# Altium schematic sheet GridSeed.SchDoc (part 1 of 2) (continued)
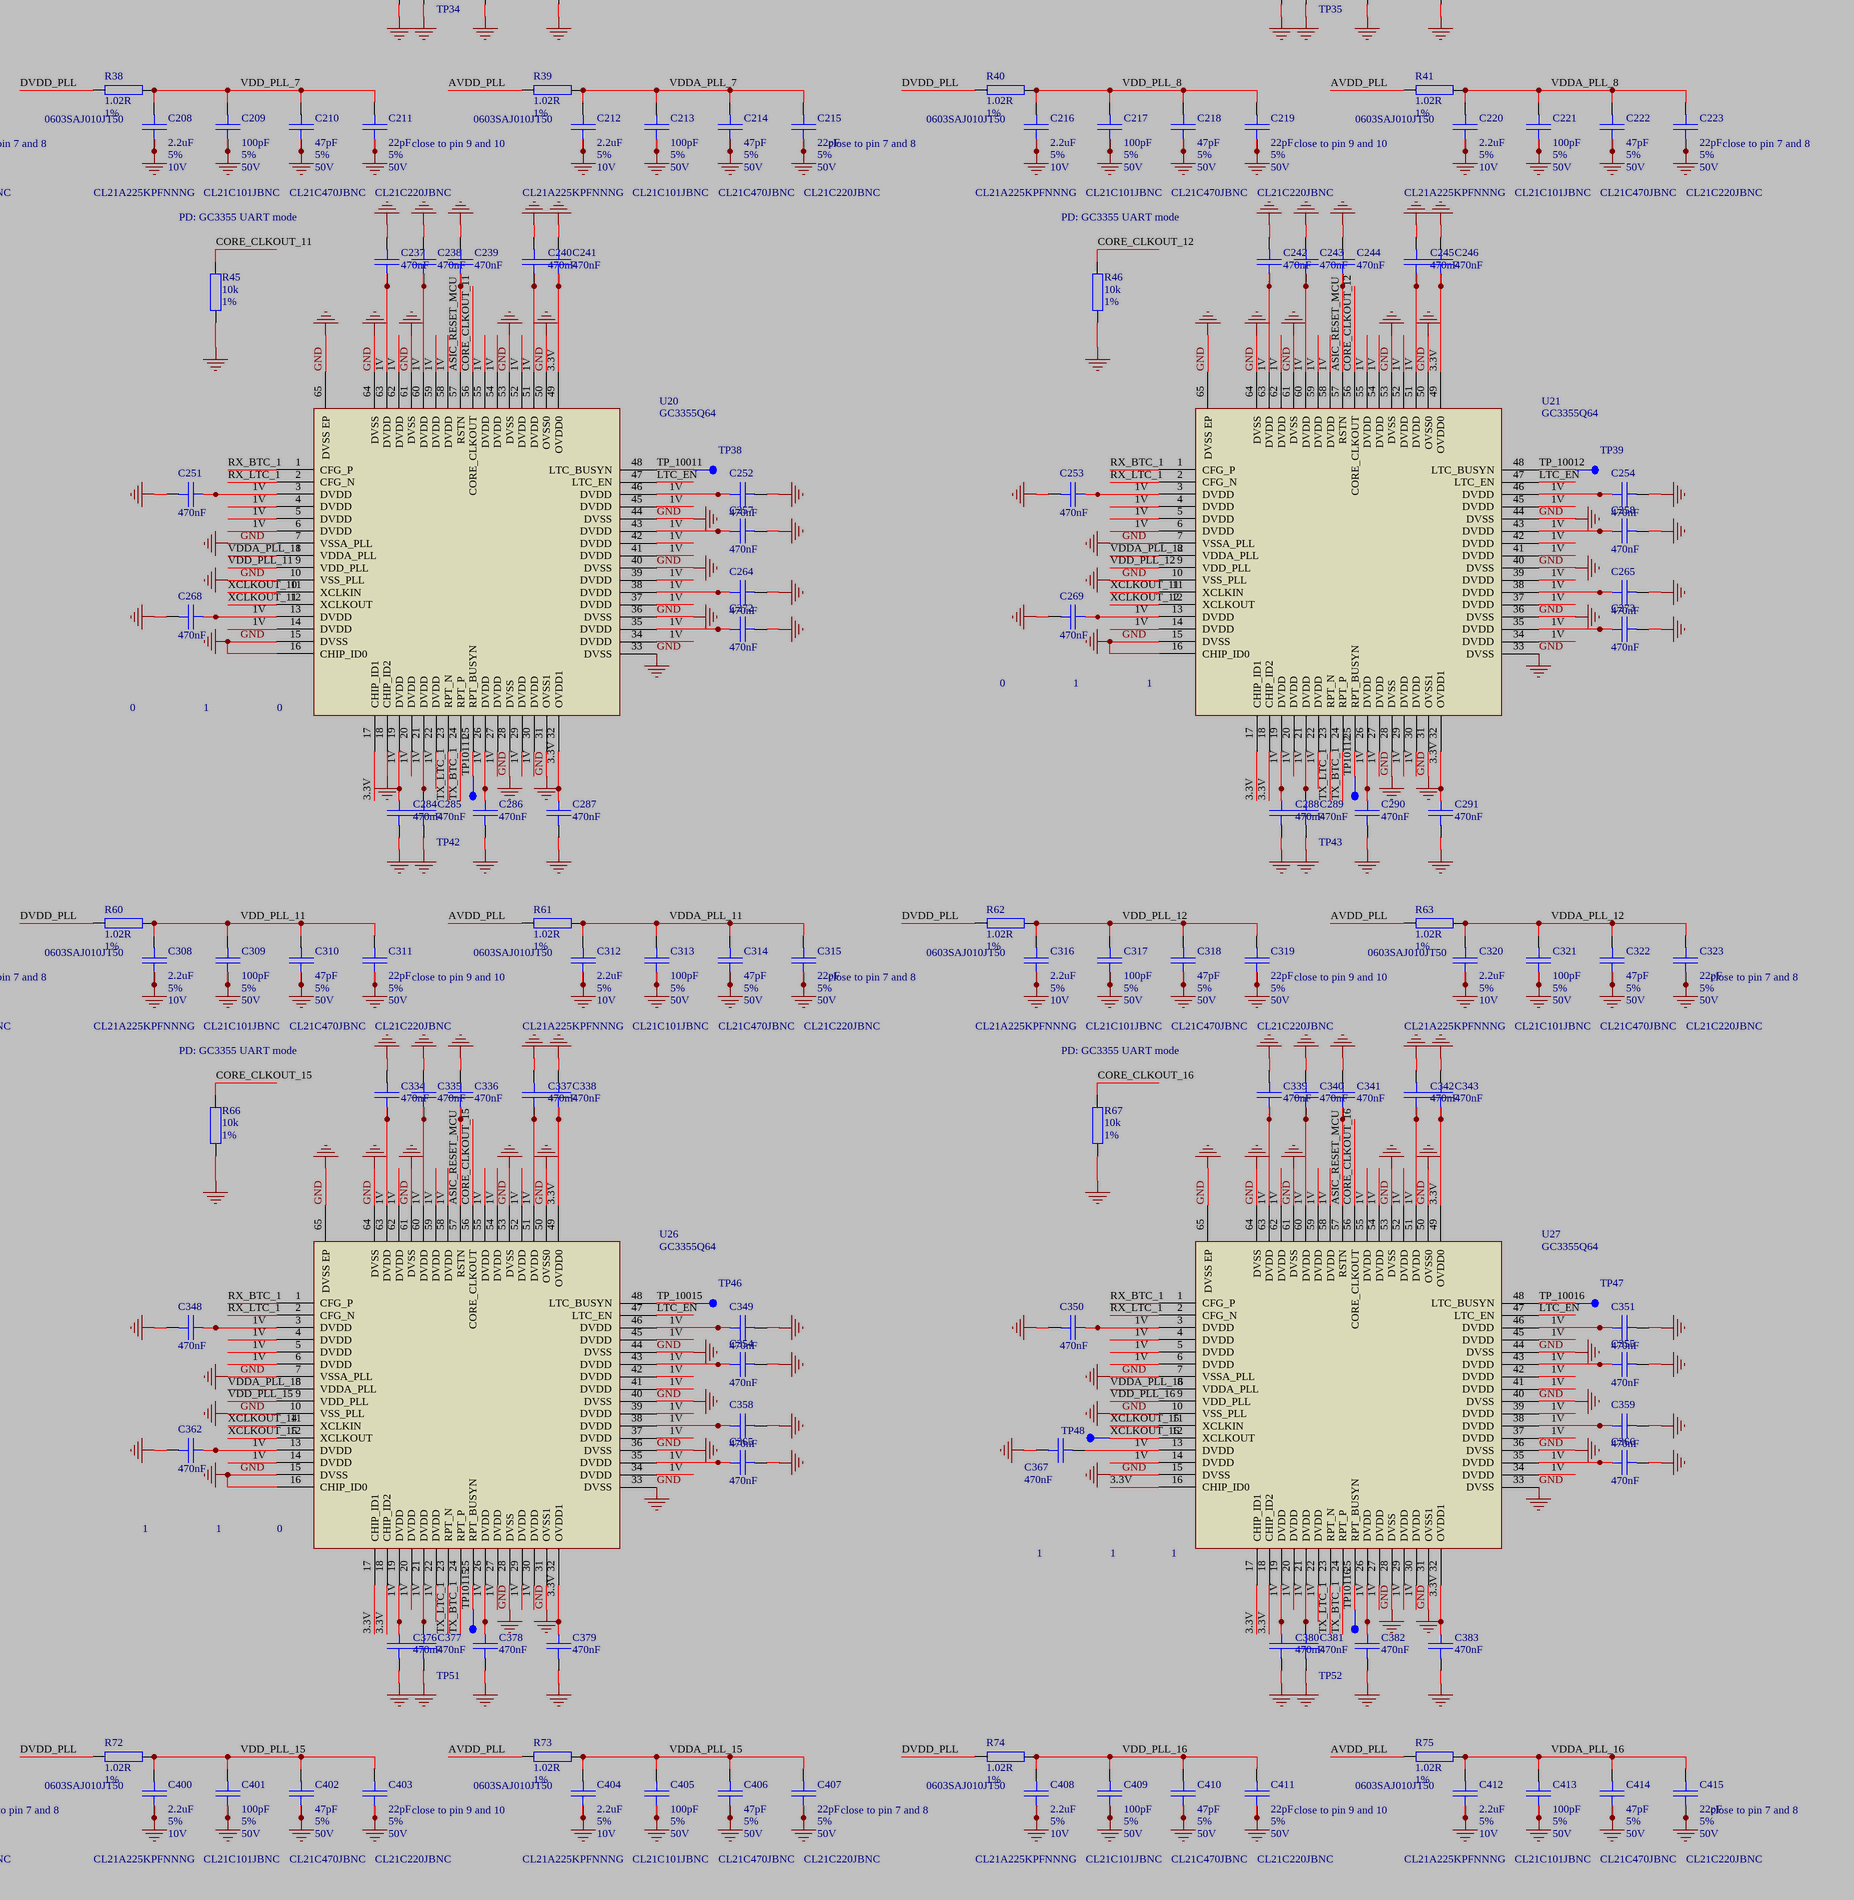
[diagram p4: GridSeed.SchDoc, bottom middle]
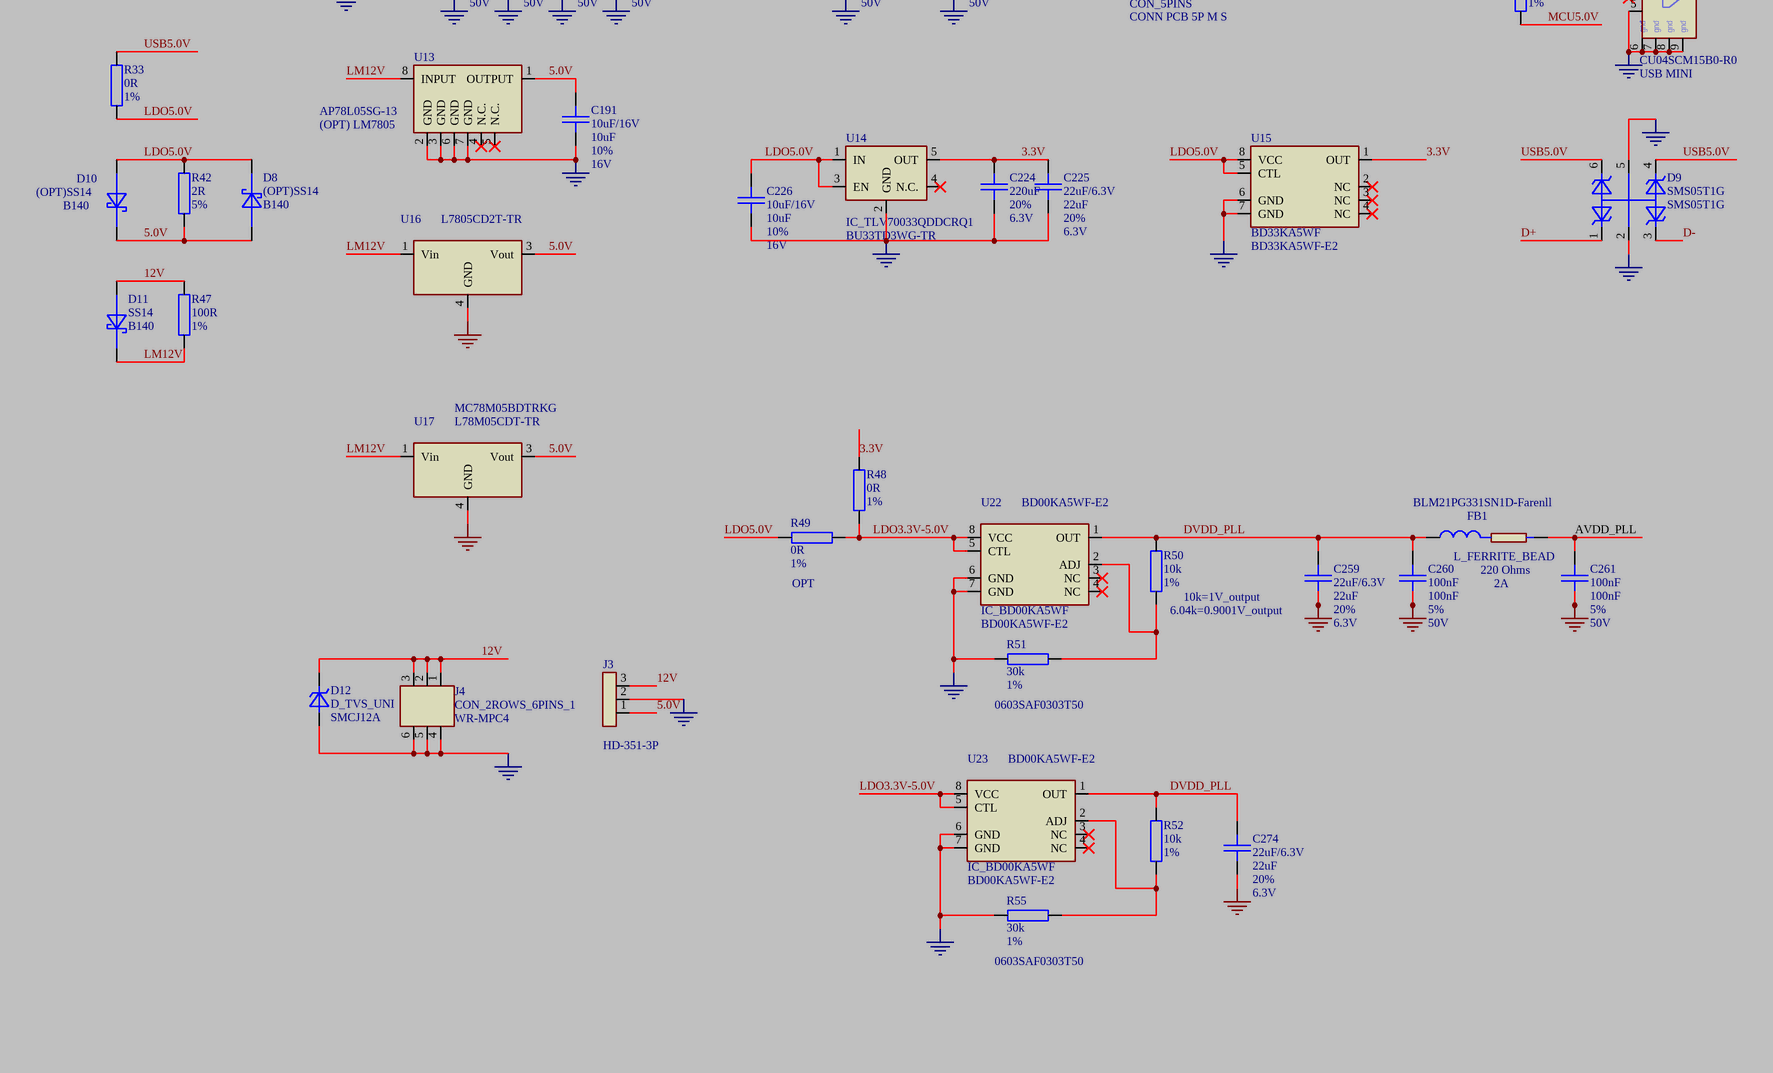
[diagram p5: GridSeed.SchDoc, bottom right]

## Parts
C1  10uF/16V  DB_VALUE: 10uF  DB_TOLERANCE: 10%  DB_VOLTAGE: 16V  [SMD_0805_CAPC2012X145N]
C2  10uF/16V  DB_VALUE: 10uF  DB_TOLERANCE: 10%  DB_VOLTAGE: 16V  [SMD_0805_CAPC2012X145N]
C3  10uF/16V  DB_VALUE: 10uF  DB_TOLERANCE: 10%  DB_VOLTAGE: 16V  [SMD_0805_CAPC2012X145N]
C4  1uF/16V  DB_VALUE: 1uF  DB_TOLERANCE: 5%  DB_VOLTAGE: 16V  [SMD_0805_CAPC2012X145N]
C5  1uF/16V  DB_VALUE: 1uF  DB_TOLERANCE: 5%  DB_VOLTAGE: 16V  [SMD_0805_CAPC2012X145N]
C6  1uF/16V  DB_VALUE: 1uF  DB_TOLERANCE: 5%  DB_VOLTAGE: 16V  [SMD_0805_CAPC2012X145N]
C7  100nF/50V  DB_VALUE: 100nF  DB_TOLERANCE: 10%  DB_VOLTAGE: 50V  [SMD_0805_CAPC2012X145N]
C8  100nF/50V  DB_VALUE: 100nF  DB_TOLERANCE: 10%  DB_VOLTAGE: 50V  [SMD_0805_CAPC2012X145N]
C9  100nF/50V  DB_VALUE: 100nF  DB_TOLERANCE: 10%  DB_VOLTAGE: 50V  [SMD_0805_CAPC2012X145N]
C10  DB_VALUE: 100uF  DB_TOLERANCE: 20%  DB_VOLTAGE: 6.3V  [SMD_1210_CAPC3225X270N]
C11  DB_VALUE: 100uF  DB_TOLERANCE: 20%  DB_VOLTAGE: 6.3V  [SMD_1210_CAPC3225X270N]
C12  DB_VALUE: 220uF  DB_TOLERANCE: 20%  DB_VOLTAGE: 6.3V  [SMD_1210_CAPC3225X270N]
C13  DB_VALUE: 220uF  DB_TOLERANCE: 20%  DB_VOLTAGE: 6.3V  [SMD_1210_CAPC3225X270N]
C14  DB_VALUE: 220uF  DB_TOLERANCE: 20%  DB_VOLTAGE: 6.3V  [SMD_1210_CAPC3225X270N]
C15  DB_VALUE: 100uF  DB_TOLERANCE: 20%  DB_VOLTAGE: 6.3V  [SMD_1210_CAPC3225X270N]
C16  DB_VALUE: 100uF  DB_TOLERANCE: 20%  DB_VOLTAGE: 6.3V  [SMD_1210_CAPC3225X270N]
C17  DB_VALUE: 220uF  DB_TOLERANCE: 20%  DB_VOLTAGE: 6.3V  [SMD_1210_CAPC3225X270N]
C18  DB_VALUE: 220uF  DB_TOLERANCE: 20%  DB_VOLTAGE: 6.3V  [SMD_1210_CAPC3225X270N]
C19  DB_VALUE: 220uF  DB_TOLERANCE: 20%  DB_VOLTAGE: 6.3V  [SMD_1210_CAPC3225X270N]
C20  DB_VALUE: 100uF  DB_TOLERANCE: 20%  DB_VOLTAGE: 6.3V  [SMD_1210_CAPC3225X270N]
C21  DB_VALUE: 100uF  DB_TOLERANCE: 20%  DB_VOLTAGE: 6.3V  [SMD_1210_CAPC3225X270N]
C22  DB_VALUE: 220uF  DB_TOLERANCE: 20%  DB_VOLTAGE: 6.3V  [SMD_1210_CAPC3225X270N]
C23  DB_VALUE: 220uF  DB_TOLERANCE: 20%  DB_VOLTAGE: 6.3V  [SMD_1210_CAPC3225X270N]
C24  DB_VALUE: 220uF  DB_TOLERANCE: 20%  DB_VOLTAGE: 6.3V  [SMD_1210_CAPC3225X270N]
C25  DB_VALUE: 470nF  [SMD_0603_CAPC1608X95N]
C26  DB_VALUE: 470nF  [SMD_0603_CAPC1608X95N]
C27  DB_VALUE: 470nF  [SMD_0603_CAPC1608X95N]
C28  DB_VALUE: 470nF  [SMD_0603_CAPC1608X95N]
C29  DB_VALUE: 470nF  [SMD_0603_CAPC1608X95N]
C30  DB_VALUE: 470nF  [SMD_0603_CAPC1608X95N]
C31  DB_VALUE: 470nF  [SMD_0603_CAPC1608X95N]
C32  DB_VALUE: 470nF  [SMD_0603_CAPC1608X95N]
C33  DB_VALUE: 470nF  [SMD_0603_CAPC1608X95N]
C34  DB_VALUE: 470nF  [SMD_0603_CAPC1608X95N]
C35  DB_VALUE: 470nF  [SMD_0603_CAPC1608X95N]
C36  DB_VALUE: 470nF  [SMD_0603_CAPC1608X95N]
C37  DB_VALUE: 470nF  [SMD_0603_CAPC1608X95N]
C38  DB_VALUE: 470nF  [SMD_0603_CAPC1608X95N]
C39  DB_VALUE: 470nF  [SMD_0603_CAPC1608X95N]
C40  DB_VALUE: 470nF  [SMD_0603_CAPC1608X95N]
C41  DB_VALUE: 470nF  [SMD_0603_CAPC1608X95N]
C42  DB_VALUE: 470nF  [SMD_0603_CAPC1608X95N]
C43  DB_VALUE: 470nF  [SMD_0603_CAPC1608X95N]
C44  DB_VALUE: 470nF  [SMD_0603_CAPC1608X95N]
C45  DB_VALUE: 470nF  [SMD_0603_CAPC1608X95N]
C46  DB_VALUE: 470nF  [SMD_0603_CAPC1608X95N]
C47  DB_VALUE: 470nF  [SMD_0603_CAPC1608X95N]
C48  DB_VALUE: 470nF  [SMD_0603_CAPC1608X95N]
C49  DB_VALUE: 470nF  [SMD_0603_CAPC1608X95N]
C50  DB_VALUE: 470nF  [SMD_0603_CAPC1608X95N]
C51  DB_VALUE: 470nF  [SMD_0603_CAPC1608X95N]
C52  DB_VALUE: 470nF  [SMD_0603_CAPC1608X95N]
C53  DB_VALUE: 470nF  [SMD_0603_CAPC1608X95N]
C54  DB_VALUE: 470nF  [SMD_0603_CAPC1608X95N]
C55  DB_VALUE: 470nF  [SMD_0603_CAPC1608X95N]
C56  DB_VALUE: 470nF  [SMD_0603_CAPC1608X95N]
C57  DB_VALUE: 470nF  [SMD_0603_CAPC1608X95N]
C58  DB_VALUE: 470nF  [SMD_0603_CAPC1608X95N]
C59  DB_VALUE: 470nF  [SMD_0603_CAPC1608X95N]
C60  DB_VALUE: 470nF  [SMD_0603_CAPC1608X95N]
C61  DB_VALUE: 470nF  [SMD_0603_CAPC1608X95N]
C62  DB_VALUE: 470nF  [SMD_0603_CAPC1608X95N]
C63  DB_VALUE: 470nF  [SMD_0603_CAPC1608X95N]
C64  DB_VALUE: 470nF  [SMD_0603_CAPC1608X95N]
C65  DB_VALUE: 470nF  [SMD_0603_CAPC1608X95N]
C66  DB_VALUE: 470nF  [SMD_0603_CAPC1608X95N]
C67  DB_VALUE: 470nF  [SMD_0603_CAPC1608X95N]
C68  DB_VALUE: 470nF  [SMD_0603_CAPC1608X95N]
C69  10uF/16V  DB_VALUE: 10uF  DB_TOLERANCE: 10%  DB_VOLTAGE: 16V  [SMD_0805_CAPC2012X145N]
C70  DB_VALUE: 470nF  [SMD_0603_CAPC1608X95N]
C71  DB_VALUE: 470nF  [SMD_0603_CAPC1608X95N]
C72  DB_VALUE: 470nF  [SMD_0603_CAPC1608X95N]
C73  DB_VALUE: 470nF  [SMD_0603_CAPC1608X95N]
C74  DB_VALUE: 470nF  [SMD_0603_CAPC1608X95N]
C75  DB_VALUE: 470nF  [SMD_0603_CAPC1608X95N]
C76  DB_VALUE: 470nF  [SMD_0603_CAPC1608X95N]
C77  DB_VALUE: 470nF  [SMD_0603_CAPC1608X95N]
C78  DB_VALUE: 470nF  [SMD_0603_CAPC1608X95N]
C79  DB_VALUE: 470nF  [SMD_0603_CAPC1608X95N]
C80  DB_VALUE: 470nF  [SMD_0603_CAPC1608X95N]
C81  DB_VALUE: 470nF  [SMD_0603_CAPC1608X95N]
C82  DB_VALUE: 470nF  [SMD_0603_CAPC1608X95N]
C83  DB_VALUE: 470nF  [SMD_0603_CAPC1608X95N]
C84  DB_VALUE: 470nF  [SMD_0603_CAPC1608X95N]
C85  DB_VALUE: 470nF  [SMD_0603_CAPC1608X95N]
C86  DB_VALUE: 2.2uF  DB_TOLERANCE: 5%  DB_VOLTAGE: 10V  [SMD_0805_CAPC2012X145N]
C87  DB_VALUE: 100pF  DB_TOLERANCE: 5%  DB_VOLTAGE: 50V  [SMD_0805_CAPC2012X145N]
C88  DB_VALUE: 47pF  DB_TOLERANCE: 5%  DB_VOLTAGE: 50V  [SMD_0805_CAPC2012X145N]
C89  DB_VALUE: 22pF  DB_TOLERANCE: 5%  DB_VOLTAGE: 50V  [SMD_0805_CAPC2012X145N]
C90  DB_VALUE: 2.2uF  DB_TOLERANCE: 5%  DB_VOLTAGE: 10V  [SMD_0805_CAPC2012X145N]
C91  DB_VALUE: 100pF  DB_TOLERANCE: 5%  DB_VOLTAGE: 50V  [SMD_0805_CAPC2012X145N]
C92  DB_VALUE: 47pF  DB_TOLERANCE: 5%  DB_VOLTAGE: 50V  [SMD_0805_CAPC2012X145N]
C93  DB_VALUE: 22pF  DB_TOLERANCE: 5%  DB_VOLTAGE: 50V  [SMD_0805_CAPC2012X145N]
C94  DB_VALUE: 2.2uF  DB_TOLERANCE: 5%  DB_VOLTAGE: 10V  [SMD_0805_CAPC2012X145N]
C95  DB_VALUE: 100pF  DB_TOLERANCE: 5%  DB_VOLTAGE: 50V  [SMD_0805_CAPC2012X145N]
C96  DB_VALUE: 47pF  DB_TOLERANCE: 5%  DB_VOLTAGE: 50V  [SMD_0805_CAPC2012X145N]
C97  DB_VALUE: 22pF  DB_TOLERANCE: 5%  DB_VOLTAGE: 50V  [SMD_0805_CAPC2012X145N]
C98  DB_VALUE: 2.2uF  DB_TOLERANCE: 5%  DB_VOLTAGE: 10V  [SMD_0805_CAPC2012X145N]
C99  DB_VALUE: 100pF  DB_TOLERANCE: 5%  DB_VOLTAGE: 50V  [SMD_0805_CAPC2012X145N]
C100  DB_VALUE: 47pF  DB_TOLERANCE: 5%  DB_VOLTAGE: 50V  [SMD_0805_CAPC2012X145N]
C101  DB_VALUE: 22pF  DB_TOLERANCE: 5%  DB_VOLTAGE: 50V  [SMD_0805_CAPC2012X145N]
C102  DB_VALUE: 2.2uF  DB_TOLERANCE: 5%  DB_VOLTAGE: 10V  [SMD_0805_CAPC2012X145N]
C103  DB_VALUE: 100pF  DB_TOLERANCE: 5%  DB_VOLTAGE: 50V  [SMD_0805_CAPC2012X145N]
C104  DB_VALUE: 47pF  DB_TOLERANCE: 5%  DB_VOLTAGE: 50V  [SMD_0805_CAPC2012X145N]
C105  DB_VALUE: 22pF  DB_TOLERANCE: 5%  DB_VOLTAGE: 50V  [SMD_0805_CAPC2012X145N]
C106  DB_VALUE: 2.2uF  DB_TOLERANCE: 5%  DB_VOLTAGE: 10V  [SMD_0805_CAPC2012X145N]
C107  DB_VALUE: 100pF  DB_TOLERANCE: 5%  DB_VOLTAGE: 50V  [SMD_0805_CAPC2012X145N]
C108  DB_VALUE: 47pF  DB_TOLERANCE: 5%  DB_VOLTAGE: 50V  [SMD_0805_CAPC2012X145N]
C109  DB_VALUE: 22pF  DB_TOLERANCE: 5%  DB_VOLTAGE: 50V  [SMD_0805_CAPC2012X145N]
C110  DB_VALUE: 2.2uF  DB_TOLERANCE: 5%  DB_VOLTAGE: 10V  [SMD_0805_CAPC2012X145N]
C111  DB_VALUE: 100pF  DB_TOLERANCE: 5%  DB_VOLTAGE: 50V  [SMD_0805_CAPC2012X145N]
C112  DB_VALUE: 47pF  DB_TOLERANCE: 5%  DB_VOLTAGE: 50V  [SMD_0805_CAPC2012X145N]
C113  DB_VALUE: 22pF  DB_TOLERANCE: 5%  DB_VOLTAGE: 50V  [SMD_0805_CAPC2012X145N]
C114  DB_VALUE: 2.2uF  DB_TOLERANCE: 5%  DB_VOLTAGE: 10V  [SMD_0805_CAPC2012X145N]
C115  DB_VALUE: 100pF  DB_TOLERANCE: 5%  DB_VOLTAGE: 50V  [SMD_0805_CAPC2012X145N]
C116  DB_VALUE: 47pF  DB_TOLERANCE: 5%  DB_VOLTAGE: 50V  [SMD_0805_CAPC2012X145N]
C117  DB_VALUE: 22pF  DB_TOLERANCE: 5%  DB_VOLTAGE: 50V  [SMD_0805_CAPC2012X145N]
C118  DB_VALUE: 470nF  [SMD_0603_CAPC1608X95N]
C119  DB_VALUE: 470nF  [SMD_0603_CAPC1608X95N]
C120  DB_VALUE: 470nF  [SMD_0603_CAPC1608X95N]
C121  DB_VALUE: 470nF  [SMD_0603_CAPC1608X95N]
C122  DB_VALUE: 470nF  [SMD_0603_CAPC1608X95N]
C123  DB_VALUE: 470nF  [SMD_0603_CAPC1608X95N]
C124  DB_VALUE: 470nF  [SMD_0603_CAPC1608X95N]
C125  DB_VALUE: 470nF  [SMD_0603_CAPC1608X95N]
C126  DB_VALUE: 470nF  [SMD_0603_CAPC1608X95N]
C127  DB_VALUE: 470nF  [SMD_0603_CAPC1608X95N]
C128  DB_VALUE: 470nF  [SMD_0603_CAPC1608X95N]
C129  DB_VALUE: 470nF  [SMD_0603_CAPC1608X95N]
C130  DB_VALUE: 470nF  [SMD_0603_CAPC1608X95N]
C131  DB_VALUE: 470nF  [SMD_0603_CAPC1608X95N]
C132  DB_VALUE: 470nF  [SMD_0603_CAPC1608X95N]
C133  DB_VALUE: 470nF  [SMD_0603_CAPC1608X95N]
C134  DB_VALUE: 470nF  [SMD_0603_CAPC1608X95N]
C135  DB_VALUE: 470nF  [SMD_0603_CAPC1608X95N]
C136  DB_VALUE: 470nF  [SMD_0603_CAPC1608X95N]
C137  DB_VALUE: 470nF  [SMD_0603_CAPC1608X95N]
C138  1nF  [SMD_0603_CAPC1608X95N]
C139  10uF/16V  DB_VALUE: 10uF  DB_TOLERANCE: 10%  DB_VOLTAGE: 16V  [SMD_0805_CAPC2012X145N]
C140  DB_VALUE: 470nF  [SMD_0603_CAPC1608X95N]
C141  DB_VALUE: 470nF  [SMD_0603_CAPC1608X95N]
C142  DB_VALUE: 470nF  [SMD_0603_CAPC1608X95N]
C143  DB_VALUE: 470nF  [SMD_0603_CAPC1608X95N]
C144  DB_VALUE: 470nF  [SMD_0603_CAPC1608X95N]
C145  DB_VALUE: 470nF  [SMD_0603_CAPC1608X95N]
C146  DB_VALUE: 470nF  [SMD_0603_CAPC1608X95N]
C147  DB_VALUE: 470nF  [SMD_0603_CAPC1608X95N]
C148  DB_VALUE: 470nF  [SMD_0603_CAPC1608X95N]
C149  DB_VALUE: 470nF  [SMD_0603_CAPC1608X95N]
C150  DB_VALUE: 470nF  [SMD_0603_CAPC1608X95N]
C151  DB_VALUE: 470nF  [SMD_0603_CAPC1608X95N]
C152  DB_VALUE: 470nF  [SMD_0603_CAPC1608X95N]
C153  DB_VALUE: 470nF  [SMD_0603_CAPC1608X95N]
C154  DB_VALUE: 470nF  [SMD_0603_CAPC1608X95N]
C155  DB_VALUE: 470nF  [SMD_0603_CAPC1608X95N]
C156  DB_VALUE: 470nF  [SMD_0603_CAPC1608X95N]
C157  DB_VALUE: 470nF  [SMD_0603_CAPC1608X95N]
C158  DB_VALUE: 470nF  [SMD_0603_CAPC1608X95N]
C159  DB_VALUE: 470nF  [SMD_0603_CAPC1608X95N]
C160  DB_VALUE: 470nF  [SMD_0603_CAPC1608X95N]
C161  DB_VALUE: 470nF  [SMD_0603_CAPC1608X95N]
C162  DB_VALUE: 470nF  [SMD_0603_CAPC1608X95N]
C163  DB_VALUE: 470nF  [SMD_0603_CAPC1608X95N]
C164  1nF  DB_TOLERANCE: 5%  DB_VOLTAGE: 25V  [SMD_0603_CAPC1608X95N]
C165  1nF  DB_TOLERANCE: 5%  DB_VOLTAGE: 25V  [SMD_0603_CAPC1608X95N]
C166  1nF  DB_TOLERANCE: 5%  DB_VOLTAGE: 25V  [SMD_0603_CAPC1608X95N]
C167  100nF  DB_TOLERANCE: 5%  DB_VOLTAGE: 50V  [SMD_0603_CAPC1608X95N]
C168  100nF  DB_TOLERANCE: 5%  DB_VOLTAGE: 50V  [SMD_0603_CAPC1608X95N]
C169  100nF  DB_TOLERANCE: 5%  DB_VOLTAGE: 50V  [SMD_0603_CAPC1608X95N]
C170  100nF  DB_TOLERANCE: 5%  DB_VOLTAGE: 50V  [SMD_0603_CAPC1608X95N]
C171  100nF  DB_TOLERANCE: 5%  DB_VOLTAGE: 50V  [SMD_0603_CAPC1608X95N]
C172  100nF  DB_TOLERANCE: 5%  DB_VOLTAGE: 50V  [SMD_0603_CAPC1608X95N]
C173  18pF  DB_TOLERANCE: 5%  DB_VOLTAGE: 50V  [SMD_0603_CAPC1608X95N]
C174  18pF  DB_TOLERANCE: 5%  DB_VOLTAGE: 50V  [SMD_0603_CAPC1608X95N]
C175  DB_VALUE: 470nF  [SMD_0603_CAPC1608X95N]
C176  DB_VALUE: 470nF  [SMD_0603_CAPC1608X95N]
C177  DB_VALUE: 470nF  [SMD_0603_CAPC1608X95N]
C178  DB_VALUE: 470nF  [SMD_0603_CAPC1608X95N]
C179  DB_VALUE: 470nF  [SMD_0603_CAPC1608X95N]
C180  DB_VALUE: 470nF  [SMD_0603_CAPC1608X95N]
C181  DB_VALUE: 470nF  [SMD_0603_CAPC1608X95N]
C182  DB_VALUE: 470nF  [SMD_0603_CAPC1608X95N]
C183  DB_VALUE: 470nF  [SMD_0603_CAPC1608X95N]
C184  DB_VALUE: 470nF  [SMD_0603_CAPC1608X95N]
C185  DB_VALUE: 470nF  [SMD_0603_CAPC1608X95N]
C186  DB_VALUE: 470nF  [SMD_0603_CAPC1608X95N]
C187  DB_VALUE: 470nF  [SMD_0603_CAPC1608X95N]
C188  DB_VALUE: 470nF  [SMD_0603_CAPC1608X95N]
C189  DB_VALUE: 470nF  [SMD_0603_CAPC1608X95N]
C190  DB_VALUE: 470nF  [SMD_0603_CAPC1608X95N]
C191  10uF/16V  DB_VALUE: 10uF  DB_TOLERANCE: 10%  DB_VOLTAGE: 16V  [SMD_0805_CAPC2012X145N]
C192  DB_VALUE: 2.2uF  DB_TOLERANCE: 5%  DB_VOLTAGE: 10V  [SMD_0805_CAPC2012X145N]
C193  DB_VALUE: 100pF  DB_TOLERANCE: 5%  DB_VOLTAGE: 50V  [SMD_0805_CAPC2012X145N]
C194  47pF  DB_TOLERANCE: 5%  DB_VOLTAGE: 50V  [SMD_0805_CAPC2012X145N]
C195  DB_VALUE: 22pF  DB_TOLERANCE: 5%  DB_VOLTAGE: 50V  [SMD_0805_CAPC2012X145N]
C196  DB_VALUE: 2.2uF  DB_TOLERANCE: 5%  DB_VOLTAGE: 10V  [SMD_0805_CAPC2012X145N]
C197  DB_VALUE: 100pF  DB_TOLERANCE: 5%  DB_VOLTAGE: 50V  [SMD_0805_CAPC2012X145N]
C198  DB_VALUE: 47pF  DB_TOLERANCE: 5%  DB_VOLTAGE: 50V  [SMD_0805_CAPC2012X145N]
C199  DB_VALUE: 22pF  DB_TOLERANCE: 5%  DB_VOLTAGE: 50V  [SMD_0805_CAPC2012X145N]
C200  DB_VALUE: 2.2uF  DB_TOLERANCE: 5%  DB_VOLTAGE: 10V  [SMD_0805_CAPC2012X145N]
C201  DB_VALUE: 100pF  DB_TOLERANCE: 5%  DB_VOLTAGE: 50V  [SMD_0805_CAPC2012X145N]
C202  DB_VALUE: 47pF  DB_TOLERANCE: 5%  DB_VOLTAGE: 50V  [SMD_0805_CAPC2012X145N]
C203  DB_VALUE: 22pF  DB_TOLERANCE: 5%  DB_VOLTAGE: 50V  [SMD_0805_CAPC2012X145N]
C204  DB_VALUE: 2.2uF  DB_TOLERANCE: 5%  DB_VOLTAGE: 10V  [SMD_0805_CAPC2012X145N]
C205  DB_VALUE: 100pF  DB_TOLERANCE: 5%  DB_VOLTAGE: 50V  [SMD_0805_CAPC2012X145N]
C206  DB_VALUE: 47pF  DB_TOLERANCE: 5%  DB_VOLTAGE: 50V  [SMD_0805_CAPC2012X145N]
C207  DB_VALUE: 22pF  DB_TOLERANCE: 5%  DB_VOLTAGE: 50V  [SMD_0805_CAPC2012X145N]
C208  DB_VALUE: 2.2uF  DB_TOLERANCE: 5%  DB_VOLTAGE: 10V  [SMD_0805_CAPC2012X145N]
C209  DB_VALUE: 100pF  DB_TOLERANCE: 5%  DB_VOLTAGE: 50V  [SMD_0805_CAPC2012X145N]
C210  DB_VALUE: 47pF  DB_TOLERANCE: 5%  DB_VOLTAGE: 50V  [SMD_0805_CAPC2012X145N]
C211  DB_VALUE: 22pF  DB_TOLERANCE: 5%  DB_VOLTAGE: 50V  [SMD_0805_CAPC2012X145N]
C212  DB_VALUE: 2.2uF  DB_TOLERANCE: 5%  DB_VOLTAGE: 10V  [SMD_0805_CAPC2012X145N]
C213  DB_VALUE: 100pF  DB_TOLERANCE: 5%  DB_VOLTAGE: 50V  [SMD_0805_CAPC2012X145N]
C214  DB_VALUE: 47pF  DB_TOLERANCE: 5%  DB_VOLTAGE: 50V  [SMD_0805_CAPC2012X145N]
C215  DB_VALUE: 22pF  DB_TOLERANCE: 5%  DB_VOLTAGE: 50V  [SMD_0805_CAPC2012X145N]
C216  DB_VALUE: 2.2uF  DB_TOLERANCE: 5%  DB_VOLTAGE: 10V  [SMD_0805_CAPC2012X145N]
C217  DB_VALUE: 100pF  DB_TOLERANCE: 5%  DB_VOLTAGE: 50V  [SMD_0805_CAPC2012X145N]
C218  DB_VALUE: 47pF  DB_TOLERANCE: 5%  DB_VOLTAGE: 50V  [SMD_0805_CAPC2012X145N]
C219  DB_VALUE: 22pF  DB_TOLERANCE: 5%  DB_VOLTAGE: 50V  [SMD_0805_CAPC2012X145N]
C220  DB_VALUE: 2.2uF  DB_TOLERANCE: 5%  DB_VOLTAGE: 10V  [SMD_0805_CAPC2012X145N]
C221  DB_VALUE: 100pF  DB_TOLERANCE: 5%  DB_VOLTAGE: 50V  [SMD_0805_CAPC2012X145N]
C222  DB_VALUE: 47pF  DB_TOLERANCE: 5%  DB_VOLTAGE: 50V  [SMD_0805_CAPC2012X145N]
C223  DB_VALUE: 22pF  DB_TOLERANCE: 5%  DB_VOLTAGE: 50V  [SMD_0805_CAPC2012X145N]
C224  DB_VALUE: 220uF  DB_TOLERANCE: 20%  DB_VOLTAGE: 6.3V  [SMD_1210_CAPC3225X270N]
C225  22uF/6.3V  DB_VALUE: 22uF  DB_TOLERANCE: 20%  DB_VOLTAGE: 6.3V  [SMD_0805_CAPC2012X145N]
C226  10uF/16V  DB_VALUE: 10uF  DB_TOLERANCE: 10%  DB_VOLTAGE: 16V  [SMD_0805_CAPC2012X145N]
C227  DB_VALUE: 470nF  [SMD_0603_CAPC1608X95N]
C228  DB_VALUE: 470nF  [SMD_0603_CAPC1608X95N]
C229  DB_VALUE: 470nF  [SMD_0603_CAPC1608X95N]
C230  DB_VALUE: 470nF  [SMD_0603_CAPC1608X95N]
C231  DB_VALUE: 470nF  [SMD_0603_CAPC1608X95N]
C232  DB_VALUE: 470nF  [SMD_0603_CAPC1608X95N]
C233  DB_VALUE: 470nF  [SMD_0603_CAPC1608X95N]
C234  DB_VALUE: 470nF  [SMD_0603_CAPC1608X95N]
C235  DB_VALUE: 470nF  [SMD_0603_CAPC1608X95N]
C236  DB_VALUE: 470nF  [SMD_0603_CAPC1608X95N]
C237  DB_VALUE: 470nF  [SMD_0603_CAPC1608X95N]
C238  DB_VALUE: 470nF  [SMD_0603_CAPC1608X95N]
C239  DB_VALUE: 470nF  [SMD_0603_CAPC1608X95N]
C240  DB_VALUE: 470nF  [SMD_0603_CAPC1608X95N]
C241  DB_VALUE: 470nF  [SMD_0603_CAPC1608X95N]
C242  DB_VALUE: 470nF  [SMD_0603_CAPC1608X95N]
C243  DB_VALUE: 470nF  [SMD_0603_CAPC1608X95N]
C244  DB_VALUE: 470nF  [SMD_0603_CAPC1608X95N]
C245  DB_VALUE: 470nF  [SMD_0603_CAPC1608X95N]
C246  DB_VALUE: 470nF  [SMD_0603_CAPC1608X95N]
C247  DB_VALUE: 470nF  [SMD_0603_CAPC1608X95N]
C248  DB_VALUE: 470nF  [SMD_0603_CAPC1608X95N]
C249  DB_VALUE: 470nF  [SMD_0603_CAPC1608X95N]
C250  DB_VALUE: 470nF  [SMD_0603_CAPC1608X95N]
C251  DB_VALUE: 470nF  [SMD_0603_CAPC1608X95N]
C252  DB_VALUE: 470nF  [SMD_0603_CAPC1608X95N]
C253  DB_VALUE: 470nF  [SMD_0603_CAPC1608X95N]
C254  DB_VALUE: 470nF  [SMD_0603_CAPC1608X95N]
C255  DB_VALUE: 470nF  [SMD_0603_CAPC1608X95N]
C256  DB_VALUE: 470nF  [SMD_0603_CAPC1608X95N]
C257  DB_VALUE: 470nF  [SMD_0603_CAPC1608X95N]
C258  DB_VALUE: 470nF  [SMD_0603_CAPC1608X95N]
C259  22uF/6.3V  DB_VALUE: 22uF  DB_TOLERANCE: 20%  DB_VOLTAGE: 6.3V  [SMD_0805_CAPC2012X145N]
C260  100nF  DB_TOLERANCE: 5%  DB_VOLTAGE: 50V  [SMD_0603_CAPC1608X95N]
C261  100nF  DB_TOLERANCE: 5%  DB_VOLTAGE: 50V  [SMD_0603_CAPC1608X95N]
C262  DB_VALUE: 470nF  [SMD_0603_CAPC1608X95N]
C263  DB_VALUE: 470nF  [SMD_0603_CAPC1608X95N]
C264  DB_VALUE: 470nF  [SMD_0603_CAPC1608X95N]
C265  DB_VALUE: 470nF  [SMD_0603_CAPC1608X95N]
C266  DB_VALUE: 470nF  [SMD_0603_CAPC1608X95N]
C267  DB_VALUE: 470nF  [SMD_0603_CAPC1608X95N]
C268  DB_VALUE: 470nF  [SMD_0603_CAPC1608X95N]
C269  DB_VALUE: 470nF  [SMD_0603_CAPC1608X95N]
C270  DB_VALUE: 470nF  [SMD_0603_CAPC1608X95N]
C271  DB_VALUE: 470nF  [SMD_0603_CAPC1608X95N]
C272  DB_VALUE: 470nF  [SMD_0603_CAPC1608X95N]
C273  DB_VALUE: 470nF  [SMD_0603_CAPC1608X95N]
C274  22uF/6.3V  DB_VALUE: 22uF  DB_TOLERANCE: 20%  DB_VOLTAGE: 6.3V  [SMD_0805_CAPC2012X145N]
C275  10uF/16V  DB_VALUE: 10uF  DB_TOLERANCE: 10%  DB_VOLTAGE: 16V  [SMD_0805_CAPC2012X145N]
C276  DB_VALUE: 470nF  [SMD_0603_CAPC1608X95N]
C277  DB_VALUE: 470nF  [SMD_0603_CAPC1608X95N]